# EasyEDA Pro project sle_keyboard.eprj, board PCB1 (continued)
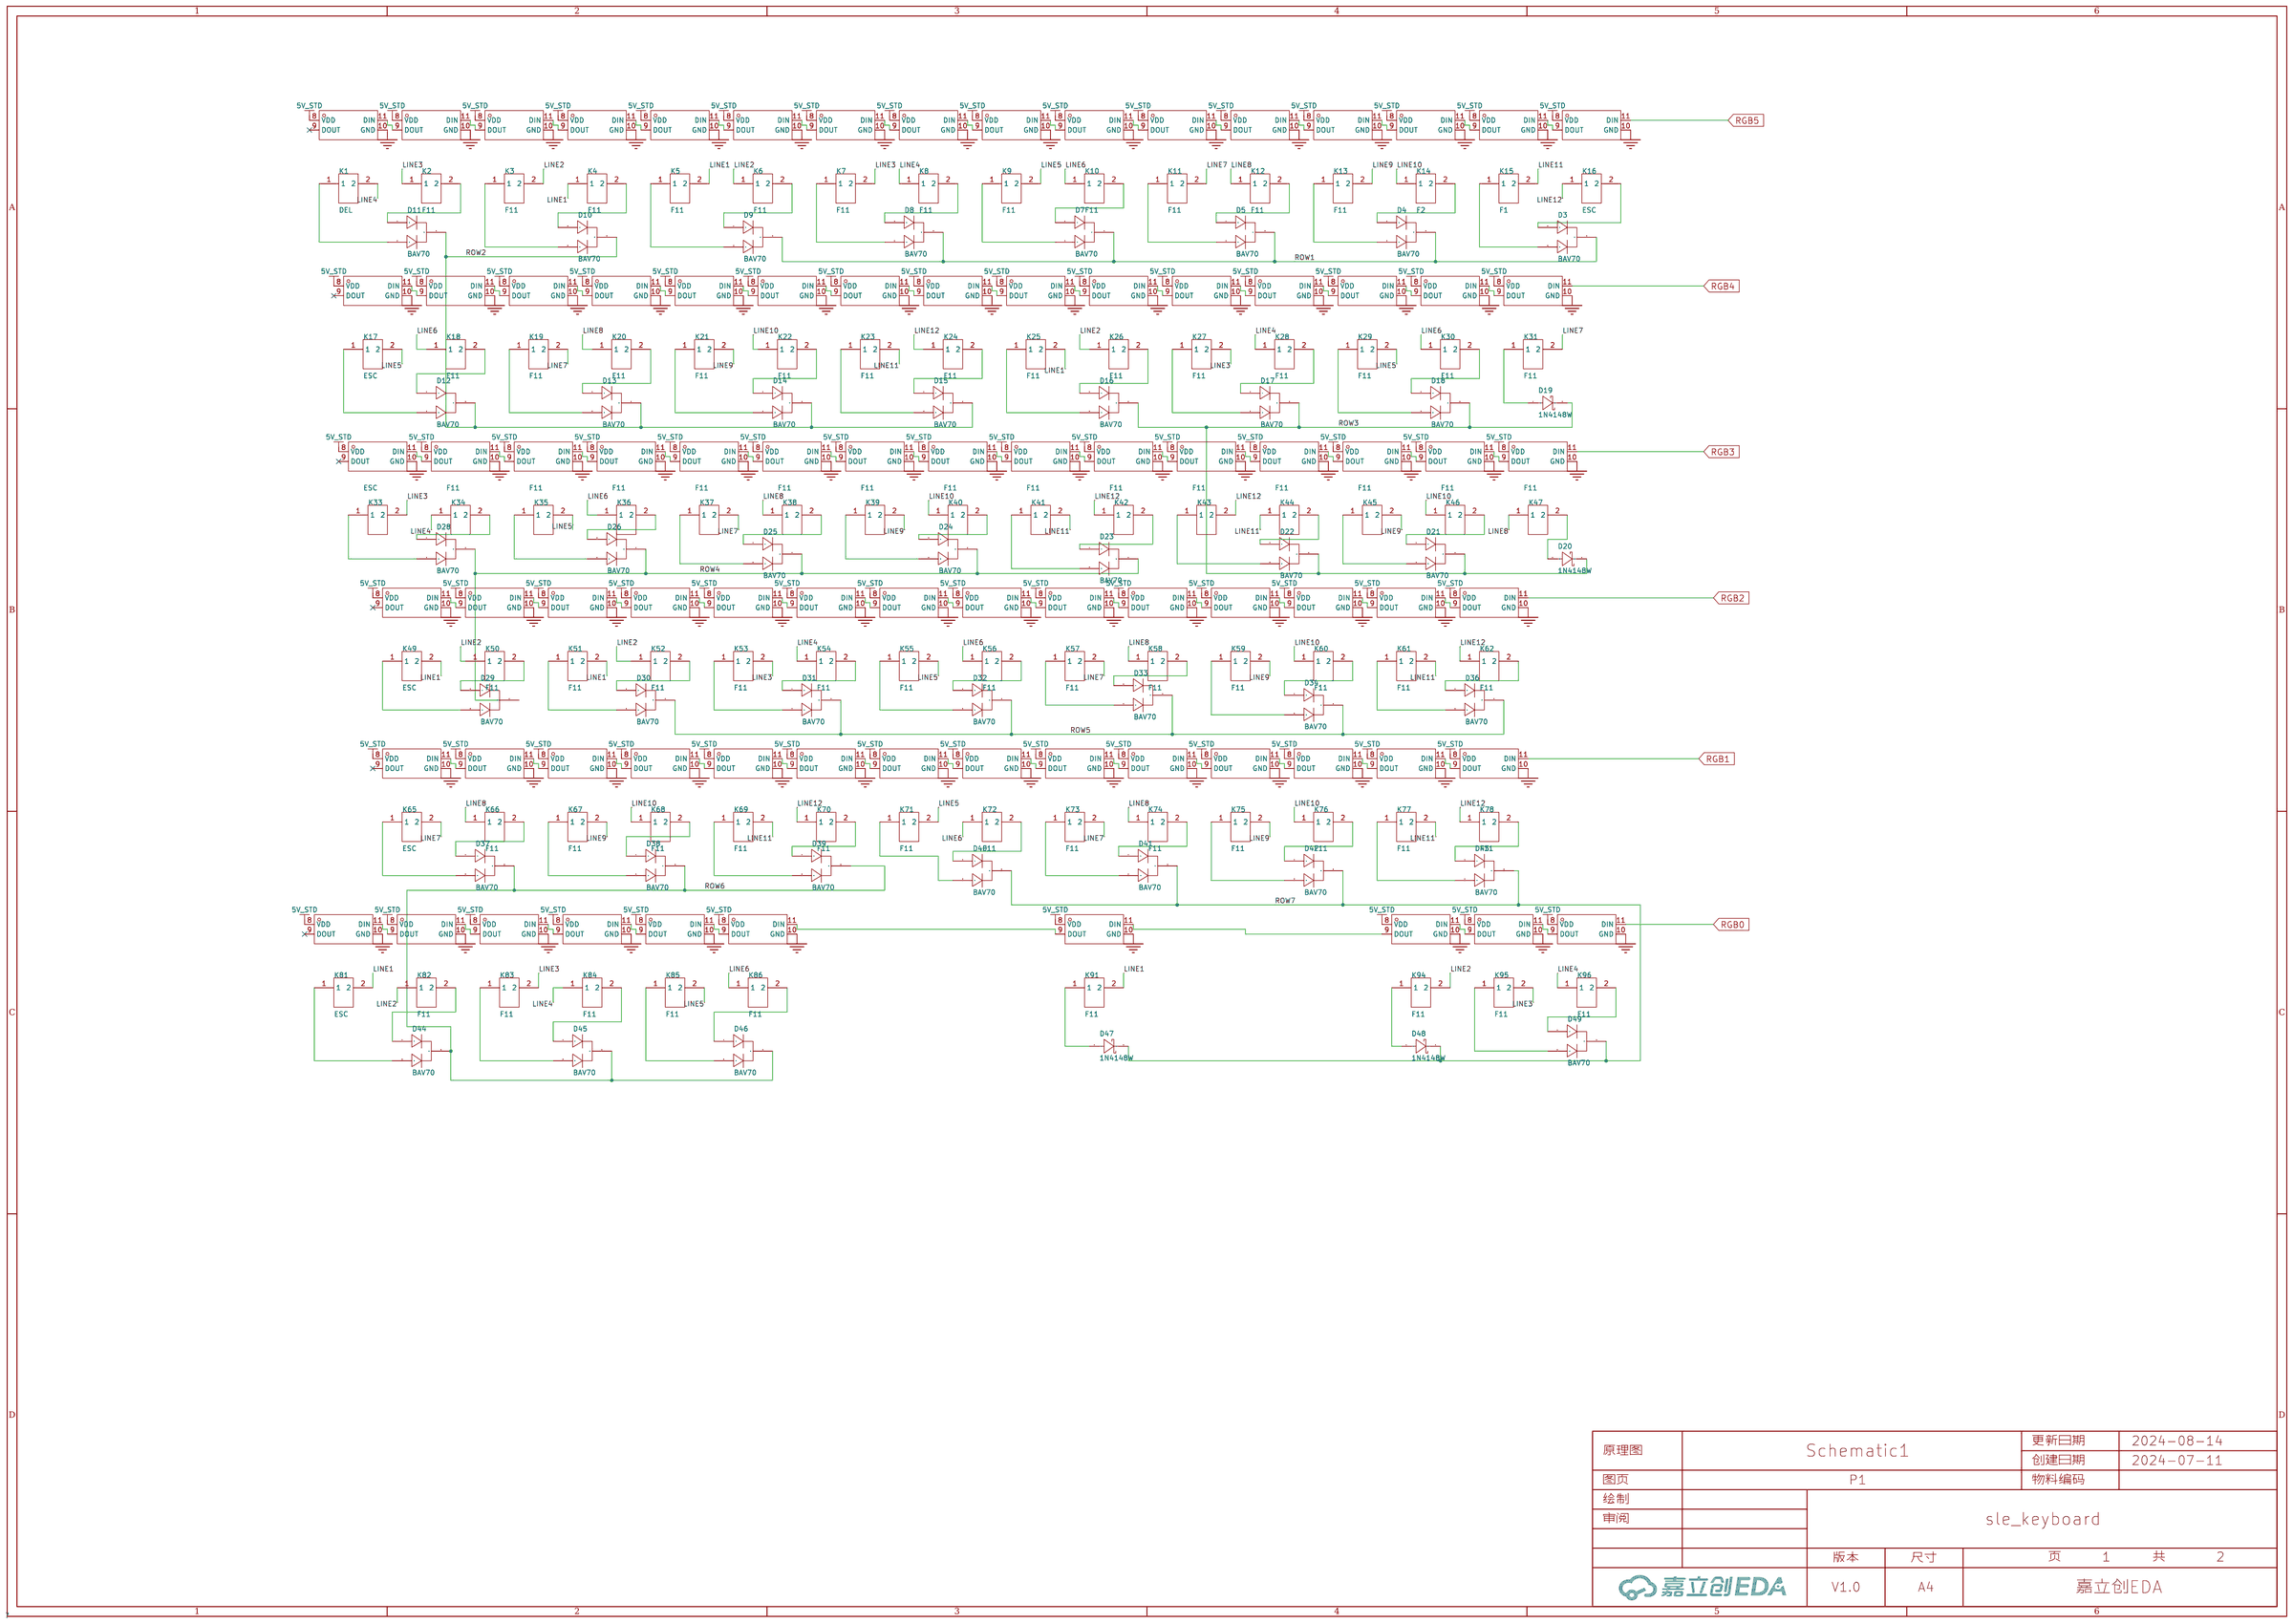
[diagram p0: P1]
## Routing (per net, layer and track width the routed paths; a pad name or vN(x,y) marks a point on that pad's centre or on a via; arc(x,y) is an arc through that point) (continued)
$1N23502: length 7.5
  Top Layer w0.178: D23.2 179.71,67.59 179.71,63.37 177.8,61.47
$1N23509: length 4.8
  Top Layer w0.178: K42.2 183.14,66.06 181.16,68.03
$1N23514: length 6.4
  Top Layer w0.178: 139.7,61.47 140.78,62.55 D24.2
$1N23521: length 4.4
  Top Layer w0.178: K40.2 145.04,65.04 D24.1
$1N23531: length 7.8
  Top Layer w0.178: 101.6,61.47 102.11,61.97 102.11,63.12 103.32,64.33 D25.2
$1N23540: length 5.2
  Top Layer w0.178: K38.2 106.94,66.82 D25.1
$1N23550: length 7.7
  Top Layer w0.178: D26.2 65.73,63.69 63.5,61.47
$1N23560: length 4.8
  Top Layer w0.178: 67.62,68.28 68.84,67.07 K36.2
$1N23565: length 9
  Top Layer w0.178: K33.1 20.26,65.85 D28.2
$1N23572: length 6.2
  Top Layer w0.178: D28.1 25.98,64.85 K34.2
$1N23582: length 7.4
  Top Layer w0.178: K50.2 28.8,44.96 D29.1
$1N23587: length 9
  Top Layer w0.178: D29.2 24.36,42.42 K49.1
$1N23594: length 7
  Top Layer w0.178: D30.2 79.57,44.19 K51.1
$1N23601: length 4.5
  Top Layer w0.178: D30.1 81.47,46.61 K52.2
$1N23611: length 8.8
  Top Layer w0.178: D31.2 117.54,44.07 K53.1
$1N23618: length 6.3
  Top Layer w0.178: D31.1 119.44,46.74 K54.2
$1N23623: length 7.9
  Top Layer w0.178: K55.1 156.02,44.45 D32.2
$1N23630: length 5.1
  Top Layer w0.178: D32.1 157.92,46.36 K56.2
$1N23640: length 8.2
  Top Layer w0.178: D33.2 194.63,44.96 K57.1
$1N23653: length 5
  Top Layer w0.178: K58.2 196.53,45.85 D33.1
$1N23662: length 8
  Top Layer w0.178: D34.2 232.35,44.57 K59.1
$1N23681: length 5.1
  Top Layer w0.178: K60.2 234.25,46.23 D34.1
$1N23689: length 7.4
  Top Layer w0.178: 275.68,42.48 275.61,42.42 K61.1
$1N23696: length 6.9
  Top Layer w0.178: K62.2 276.39,40.58 D36.1
$1N23701: length 9.4
  Top Layer w0.178: D43.2 262.49,23.37 K77.1
$1N23708: length 8.2
  Top Layer w0.178: K78.2 269.9,25.91 D43.1
$1N23718: length 8.4
  Top Layer w0.178: K75.1 222.32,25.02 D42.2
$1N23725: length 5.9
  Top Layer w0.178: K76.2 224.22,27.69 D42.1
$1N23730: length 7.2
  Top Layer w0.178: D41.2 183.82,24.62 K73.1
$1N23737: length 5.1
  Top Layer w0.178: K74.2 187.9,27.89 185.72,30.07
$1N23747: length 7.9
  Top Layer w0.178: K71.1 146.5,25.4 D40.2
$1N23758: length 5.1
  Top Layer w0.178: D40.1 149.8,29.04 K72.2
$1N23763: length 7.7
  Top Layer w0.178: K69.1 108.4,25.4 D39.2
$1N23770: length 4.9
  Top Layer w0.178: K70.2 110.3,27.31 D39.1
$1N23775: length 7.9
  Top Layer w0.178: K67.1 66.35,28.6 D38.2
$1N23782: length 6.7
  Top Layer w0.178: K68.2 71.39,25.91 D38.1
$1N23787: length 8.5
  Top Layer w0.178: D37.2 17.85,25.34 K65.1
$1N23794: length 5.8
  Top Layer w0.178: K66.2 21.21,29.61 D37.1
$1N23799: length 8.2
  Top Layer w0.178: D44.2 18.1,6.54 K81.1
$1N23806: length 5.3
  Top Layer w0.178: K82.2 21.21,10.43 D44.1
$1N23816: length 7.3
  Top Layer w0.178: K83.1 55.95,6.28 D45.2
$1N23823: length 4.5
  Top Layer w0.178: D45.1 59.31,9.29 K84.2
$1N23833: length 7
  Top Layer w0.178: D46.2 94.06,6.3 92.08,4.32
$1N23840: length 4.3
  Top Layer w0.178: D46.1 97.41,9.06 K86.2
$1N23850: length 4.4
  Top Layer w0.178: D49.2 279.23,4.32 K95.1
$1N23857: length 6.3
  Top Layer w0.178: K96.2 284.45,5.78 D49.1
$2N558: length 2.7
  Top Layer w0.254: U1.1 187.16,13 186.82,13.34 C1.2
$2N766: length 5.2
  Top Layer w0.254: R1.1 R3.2 195.71,8.51 195.22,9 U1.26
$2N778: length 4
  Top Layer w0.254: 194.62,8.6 194.62,5.72 R2.1 R4.1
$2N1058: length 6.3
  Top Layer w0.254: U1.33 196.33,11.8 197.49,12.95 197.49,14.56 C4.1
$2N1070: length 5.4
  Top Layer w0.254: C3.1 198.12,13.97 197.87,13.72 197.87,12.83 196.43,11.4 U1.32
$2N1199: length 9.3
  Top Layer w0.254: X1.1 198.84,18.5 198.25,17.91 198.25,16.76 197.1,15.62 197.1,13.09 196.21,12.2 194.62,12.2
$2N1205: length 6.7
  Top Layer w0.254: X1.3 196.72,16.68 196.72,13.21 196.11,12.59 U1.35
$2N1424: length 4.2
  Top Layer w0.254: C6.1 191.32,17.2 190.94,16.82 190.94,13.92 U1.44
$2N1593: length 4.1
  Top Layer w0.254: L1.1 188.28,16.58 189.72,15.14 U1.47
$2N1696: length 3.6
  Top Layer w0.254: U1.46 190.12,15.37 189.74,15.75 189.74,17.3
$2N2387: length 4.1
  Top Layer w0.508: 201.93,11.2 201.04,11.2 ; 200.91,11.2 197.74,11.2
$2N2497: length 3.1
  Top Layer w0.508: RF1.1 202.65,11.2
$2N2602: length 2.1
  Top Layer w0.508: 200.18,9.62 199.81,10 arc(199.15,10.44) R6.1
$2N2641: length 4.1
  Top Layer w0.508: 200.79,9.02 201.31,8.5 arc(202.24,7.1) 202.56,5.46
$2N4369: length 1.2
  Top Layer w0.28: R9.2 R11.1
$2N4395: length 1.2
  Top Layer w0.28: R10.2 R12.1
$2N4783: length 2
  Top Layer w0.508: R13.2 45.41,86.23 U3.2
$2N8971: length 25.5
  Top Layer w0.254: v1(150.5,13.46) 149.79,12.76 U5.4 149.22,12.79 R21.1 ; C21.2 157.61,11.88 157.61,15.58 156.68,16.51 155.32,16.51 154.81,16 154.81,13.36 Q1.1 153.86,12.76 v1(153.16,13.46)
  Top Layer w0.762: SW2.1 SW2.2 159.8,10.61 C21.2
  Bottom Layer w0.254: v1(153.16,13.46) v1(150.5,13.46)
$2N9152: length 3.5
  Top Layer w1.016: R22.2 156.68,14.12 Q1.3
$2N9229: length 1.8
  Top Layer w0.254: U5.3 151.77,12.79 R23.2
$2N10910: length 63.8
  Top Layer w0.508: 23.08,85.67 23.08,87.68 22.68,88.08 22.68,88.38
  Top Layer w1.016: 21.82,88.39 v1(21.82,82.34) ; 21.78,34.84 21.78,38.76 22.17,39.15
  Bottom Layer w1.016: v1(21.82,80.63) v1(21.82,81.44) v1(21.82,82.34) 21.85,82.31 21.85,76.94 18.36,73.45 18.36,43.88 19.35,42.89 21.32,42.89 21.82,42.39 21.82,37.7
  vias: v1(21.76,37.7) v1(21.82,34.86)
$2N23725: length 3
  Top Layer w0.178: 19.14,47.49 19.14,46.14 19.17,46.12
  Top Layer w0.254: 19.3,48.97 19.3,47.69 19.08,47.47

## Copper pours and planes (outline as drawn; the poured copper is in the pictures)
5V_STD on Top Layer: 19.43,54.8 20.32,54.8 20.32,52.2 19.43,52.2
5V_STD on Top Layer: 16.42,54.14 20.34,54.14 20.34,50.27 16.42,50.27
+5V on Top Layer: 45.29,83.69 47.88,83.69 47.88,81.65 45.29,81.65
+5V on Top Layer: 243.59,96.27 245.61,96.27 245.61,94.35 243.59,94.35
+5V on Top Layer: 242.32,96.24 245.26,96.24 245.26,94.78 242.32,94.78
GND on Top Layer: 199.01,7.11 201.44,7.11 201.44,5.21 199.01,5.21
GND on Top Layer: 243.97,91.06 246.25,91.06 246.25,89.79 243.97,89.79
GND on Top Layer: -16.63,134.51 313.63,134.51 313.63,-10 -16.63,-10
GND on Top Layer: 75.56,92.49 80.21,92.49 80.21,90.75 75.56,90.75
GND on Top Layer: 48.64,88.39 51.65,88.39 51.65,86.87 48.64,86.87
GND on Bottom Layer: 189.36,12.95 193.68,12.95 193.68,8.64 189.36,8.64
GND on Bottom Layer: -22.36,138.84 328.25,138.84 328.25,-15.01 -22.36,-15.01
GND on Bottom Layer: 48.71,97.03 51.56,97.03 51.56,83.85 48.71,83.85
SLE_3V3 on Top Layer: 188.2,8.2 189.42,8.2 189.42,6.99 188.2,6.99
SLE_3V3 on Top Layer: 188.47,14.83 189.32,14.83 189.32,13.4 188.47,13.4
SLE_3V3 on Top Layer: 186.46,14.86 189.32,14.86 189.32,13.4 186.46,13.4
SLE_3V3 on Top Layer: 194.12,14.39 195.12,14.39 195.12,12.9 194.12,12.9
SLE_3V3 on Top Layer: 186.08,8.3 189.22,8.3 189.22,7 186.08,7
SLE_3V3 on Top Layer: 151.38,11.18 155.7,11.18 155.7,7.24 151.38,7.24
SLE_3V3 on Bottom Layer: 187.38,14.61 188.61,14.61 188.61,7.65 187.38,7.65
SLE_3V3 on Bottom Layer: 186.18,9 188.85,9 188.85,6.99 186.18,6.99
SLE_3V3 on Bottom Layer: 188.54,14.6 195,14.6 195,13.83 188.54,13.83
SLE_3V3 on Bottom Layer: 151.51,9 155.03,9 155.03,7.49 151.51,7.49
SLE_3V3 on Bottom Layer: 187.36,14.86 188.96,14.86 188.96,13.63 187.36,13.63
SYS_3V3 on Top Layer: 23.05,55.32 28.38,55.32 28.38,50.08 23.05,50.08
SYS_3V3 on Bottom Layer: 25.02,52.29 27.84,52.29 27.84,50.08 25.02,50.08
$2N1593 on Top Layer: 186.86,17.15 189.72,17.15 189.72,14.6 186.86,14.6
$2N1696 on Top Layer: 187.55,19.05 190.19,19.05 190.19,16.91 187.55,16.91
$2N10910 on Top Layer: 21.32,82.55 22.35,82.55 22.35,80.33 21.32,80.33
$2N23447 on Top Layer: 21.22,55.06 24.44,55.06 24.44,50.6 21.22,50.6

Small or netless copper shapes (teardrops, artwork), in the pictures only: 1521 on Top Layer, 640 on Bottom Layer
